# EasyEDA Pro project ProPrj_Starcat_FOC双路矢量控制器_2024-11-11.epro, board 双路大功率矢量控制器_3 (continued)
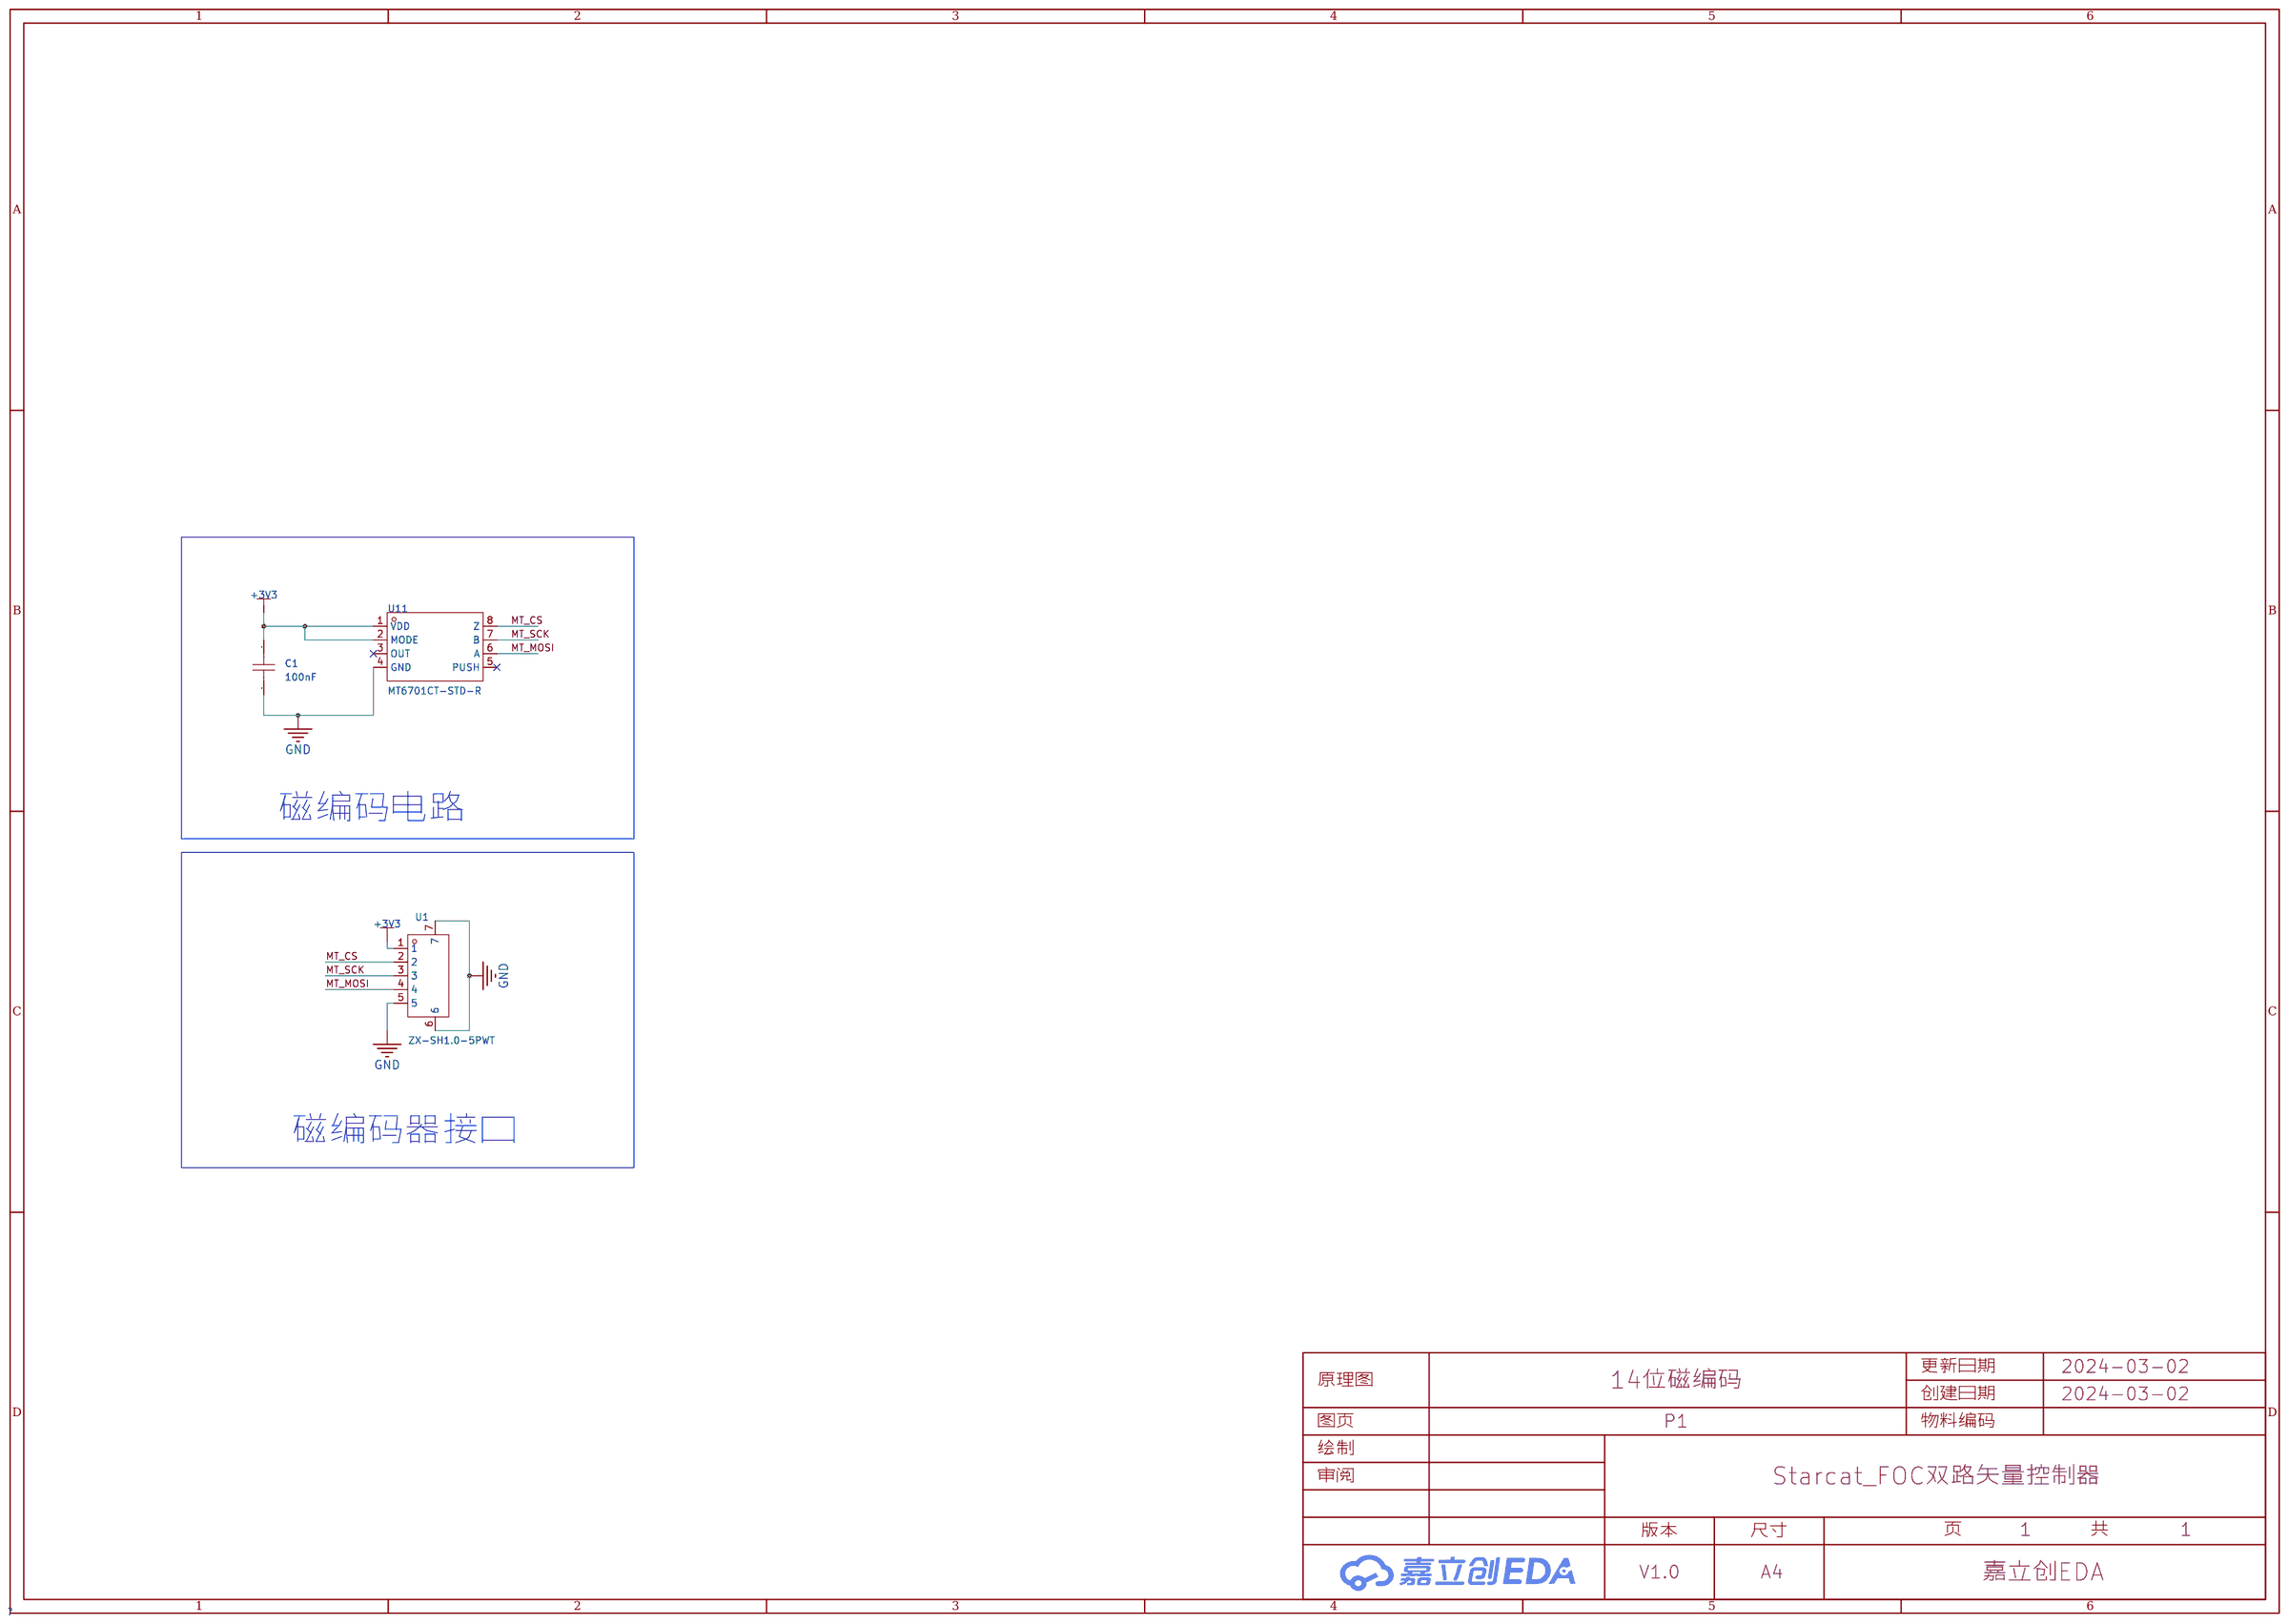
[diagram p0: schematic sheet]
## Routing (per net, layer and track width the routed paths; a pad name or vN(x,y) marks a point on that pad's centre or on a via; arc(x,y) is an arc through that point) (continued)
SL_C_1: length 40.8
  Top Layer w0.305: v1(65.74,32.13) 65.74,36.45 67.11,37.81 U15.34 ; 61.48,32.93 61.48,32.16 v1(61.47,32.15)
  Inner1 w0.305: 59.44,31.24 60.56,31.24 v1(61.47,32.15) 61.47,32.56 61.93,33.02 65.36,33.02 65.74,32.64 v1(65.74,32.13) ; 59.43,31.24 51.77,31.24 50.76,30.23 50.76,19.68 51.14,19.3 53.17,19.3 53.54,19.68 v1(53.54,20.04)
  vias: v1(51.7,23.02) v1(51.74,21.93) v1(51.8,20.65) v1(52.06,22.48) v1(52.01,21.33) v1(52.14,20.05) v1(52.36,23.03) v1(52.43,21.93) v1(52.47,20.66) v1(52.64,21.34) v1(52.7,22.49) v1(52.83,20.02) v1(52.99,23.03) v1(53.09,21.9) v1(53.12,20.64) v1(53.27,21.28) v1(53.34,22.49) v1(53.64,23.04) v1(53.71,21.89) v1(53.8,20.63) v1(53.95,22.5) v1(53.92,21.27)
SL_C_2: length 29.7
  Top Layer w0.305: 23.39,32.98 23.21,32.79 23.21,32.14 v1(22.96,31.89) ; v1(25.36,35.56) 24.74,36.18 U16.34
  Inner1 w0.305: v1(24.41,20.03) 24.41,18.86 24.1,18.55 22.17,18.55 21.67,19.05 21.67,30.61 v1(22.96,31.89) 22.96,34.56 23.96,35.56 v1(25.36,35.56)
  vias: v1(22.57,23) v1(22.61,21.91) v1(22.66,20.64) v1(22.88,21.32) v1(22.92,22.46) v1(23,20.04) v1(23.23,23.02) v1(23.3,21.91) v1(23.33,20.65) v1(23.57,22.48) v1(23.51,21.33) v1(23.69,20.01) v1(23.86,23.02) v1(23.95,21.89) v1(23.99,20.63) v1(24.14,21.27) v1(24.21,22.48) v1(24.5,23.03) v1(24.57,21.88) v1(24.67,20.62) v1(24.78,21.26) v1(24.82,22.49)
SO1_1: length 30.9
  Top Layer w0.305: R32.1 66,53.46 C66.2 65.98,54 64.85,55.12 62.19,55.12 60.92,53.85 v1(60.92,50.67) ; v1(46.97,44.76) 46.73,44.53 U12.9
  Bottom Layer w0.305: v1(60.92,50.67) 60.92,49.01 60.14,48.23 53.4,48.23 52.15,46.99 49.23,46.99 47.01,44.76 v1(46.97,44.76)
SO1_2: length 44.9
  Top Layer w0.305: U12.11 46.45,43.53 v1(46.56,43.42) ; v1(21.29,54.41) 21.29,54.84 21.45,54.99 23.07,54.99 23.51,54.55 C67.2 23.52,53.46 R34.1
  Inner1 w0.305: v1(21.29,54.41) 21.29,54.46 21.8,54.97 22.72,54.97 23.45,54.23 23.45,47.75 24.21,46.99 33.81,46.99 35.39,45.41 35.39,42.54 36.03,41.91 46.19,41.91 46.56,42.29 v1(46.56,43.42)
SO2_1: length 28.8
  Top Layer w0.305: v1(46.82,45.59) 46.25,45.03 U12.8 ; v1(60.31,49.26) 61.38,49.26 61.53,49.4 61.53,53.7 62.44,54.61 64.22,54.61 64.85,53.97 C70.2 R36.1
  Bottom Layer w0.305: v1(60.31,49.26) 59.69,48.64 53.04,48.64 51.9,47.5 48.73,47.5 v1(46.82,45.59)
SO2_2: length 43.2
  Top Layer w0.305: R38.1 22.34,53.43 C73.2 22.37,54.04 v1(22.06,54.36) ; v1(47.17,43.91) 47.06,44.03 U12.10
  Inner1 w0.305: v1(47.17,43.91) 47.2,43.88 47.2,42.16 46.44,41.4 35.77,41.4 34.88,42.29 34.88,45.34 33.74,46.48 23.71,46.48 22.94,47.24 22.94,53.97 22.56,54.36 v1(22.06,54.36)
SPI_MISO: length 56.4
  Top Layer w0.305: U16.10 31.24,49.39 30.91,49.72 ; v1(73.5,50.8) 73.61,50.69 U15.10 ; 30.91,49.77 30.87,49.81 ; v1(53.84,53.75) 53.2,53.75 52.5,53.05 U12.52
  Inner1 w0.305: 30.9,49.74 30.9,50.02 30.78,50.13 ; v1(73.5,50.8) 72.35,51.94 55.96,51.94 54.16,53.75 v1(53.84,53.75) 53.2,53.75 52.13,52.68 35.57,52.68 35.26,52.38 35.26,50.04 34.63,49.4 31.21,49.4 30.95,49.67
  vias: v1(30.87,50.03)
SPI_MOSI: length 56.2
  Top Layer w0.305: v1(31.63,50.04) 31.74,49.93 U16.9 ; U12.53 52,53.41 v1(52.52,53.93) ; U15.9 74.11,51.41 v1(74.13,51.43)
  Inner1 w0.305: v1(31.63,50.04) 34.5,50.04 34.76,50.29 34.76,52.83 35.17,53.24 51.83,53.24 v1(52.52,53.93) 53.07,54.48 54.19,54.48 56.22,52.45 73.11,52.45 v1(74.13,51.43)
SPI_SCK: length 53
  Top Layer w0.305: U16.11 30.74,49.1 30.31,49.53 v1(30.29,49.53) ; U15.11 73.11,49.91 ; U12.51 53,52.5 v1(53.5,53.01)
  Inner1 w0.305: v1(72.94,50.13) 71.63,51.43 55.71,51.43 54.14,53.01 v1(53.5,53.01) 51.93,51.43 36.97,51.43 36.66,51.13 36.66,49.53 36.03,48.89 30.93,48.89 v1(30.29,49.53)
SW1: length 53
  Top Layer w0.305: v1(49.74,36.32) 50,36.58 U12.24 ; v1(84.64,23.49) 83.9,23.49 83.4,24 83.4,28.87 v1(81.4,30.86)
  Bottom Layer w0.305: v1(49.74,36.32) 49.74,33.53 52.41,30.86 67.27,30.86 67.57,30.56 81.1,30.56 v1(81.4,30.86) ; 87.51,21.06 87.51,21.45 87.19,21.78 84.93,21.78 84.44,22.26 84.44,23.71
SW2: length 64.3
  Top Layer w0.305: U12.21 v1(48.5,35.56) ; v1(84.64,18.29) 83.78,18.29 83.27,18.8 83.27,22.35 83.78,22.86 84.92,22.86 85.3,23.24 85.3,24 84.79,24.51 84.16,24.51 83.94,24.73 83.94,25.03 83.98,25.07 83.98,29.62 81.97,31.62 v1(81.11,31.62)
  Bottom Layer w0.305: v1(81.11,31.62) 80.48,30.99 67.9,30.99 67.52,31.37 52.66,31.37 50.63,33.4 50.63,36.7 50.12,37.21 48.98,37.21 48.5,36.73 v1(48.5,35.56) ; 84.74,17.94 84.74,16.06 85.11,15.69 86.03,15.69 86.15,15.81
SWCLK: length 8.9
  Top Layer w0.305: v1(54.82,50.42) 54.71,50.53 U12.49
  Bottom Layer w0.305: v1(54.82,50.42) 54.38,49.98 48.47,49.98 48.03,50.42 47.96,50.42 47.84,50.53 CN1.2
SWDIO: length 19.9
  Top Layer w0.305: U12.46 57.71,47.53 59.92,49.74 v1(59.92,50.78)
  Bottom Layer w0.305: v1(59.92,50.78) 59.92,52.18 59.52,52.58 53.93,52.58 53.55,52.2 52.41,52.2 51.9,52.7 49.74,52.7 48.84,51.81 CN1.3
TEMP1: length 21.8
  Top Layer w0.305: R21.1 64.48,30.1 v1(63.93,30.1) ; U12.25 50.5,36.08 51.14,35.43 52.86,35.43 53.38,34.91 C35.2 53.45,34.54 v1(55.46,34.54)
  Inner2 w0.305: v1(55.46,34.54) 55.46,31.37 56.09,30.73 63.29,30.73 v1(63.93,30.1)
TEMP2: length 21
  Top Layer w0.305: U12.20 48,35.97 47.2,35.18 v1(47.07,35.18) 47.03,35.13 C36.2 48.19,34.48 R25.2
  Bottom Layer w0.305: v1(37.16,30.23) 46.69,30.23 47.07,30.61 v1(47.07,35.18)
TX: length 51.3
  Top Layer w0.305: U12.14 46.32,42.03 46.82,41.53 v1(46.82,40.64)
  Inner1 w0.305: v1(13.55,43.82) 21.3,43.82 v1(22.31,44.83)
  Bottom Layer w0.305: v1(46.82,40.64) 23.2,40.64 22.31,41.53 v1(22.31,44.83) 22.31,52.32 22.44,52.45 U4.7 ; CN2.2 v1(13.55,43.82)
V_BUS: length 7.2
  Top Layer w0.305: R23.2 R20.1 49.57,35.35 49,35.92 U12.22
$1N4243: length 16.2
  Top Layer w0.305: C17.2 18.54,50.51 18.89,50.16 19.4,50.16 21.61,47.94 21.61,46.29 22.18,45.72 22.33,45.72 v1(23.09,44.96)
  Bottom Layer w0.305: U4.8 23.09,50.67 v1(23.09,44.96)
$1N23108: length 1
  Top Layer w0.305: 49.74,53.09 50.71,53.09 LED2.2
$1N53421: length 1.3
  Top Layer w0.305: 14.09,35.94 14.16,36.01 R7.1
$1N65020: length 6.3
  Top Layer w0.305: C13.2 57.55,37.74 57.2,37.39 53.8,37.39 53.5,37.7 U12.31
$1N65024: length 4.7
  Top Layer w0.305: U12.47 57.64,48.03 58.89,49.28 C14.2
$1N65085: length 2.7
  Top Layer w0.305: U12.60 48.5,52.86 48.73,53.09
$1N74568: length 2.7
  Bottom Layer w0.762: D1.1 15.55,37.16 F1.2
$1N75995: length 1.8
  Top Layer w0.305: LED1.2 88.02,33.03 R1.1
$1N76797: length 17.5
  Bottom Layer w0.305: C24.1 76.28,33.65 79.71,33.65 80.5,34.44 80.5,43.66 79.97,44.2 78.04,44.2 U10.3
$1N76851: length 12.6
  Bottom Layer w0.305: U10.6 79.79,42.09 80.09,41.79 80.09,34.8 79.7,34.41 R19.2
$1N77635: length 3.8
  Bottom Layer w0.305: U6.3 83.03,52.01 83.09,52.07 83.4,52.07 83.68,51.78 R11.1 84.78,50.62 R15.2
$1N77907: length 5.8
  Bottom Layer w0.305: L5.1 78.62,54.86 82.13,54.86 82.38,54.61 82.38,54.03 U6.1
$2N6130: length 8.1
  Top Layer w0.305: 84.03,50.81 84.03,50.29 83.78,50.04 81.87,50.04 81.31,49.48 78.48,49.48 78.11,49.1 U15.1
$2N6321: length 7.4
  Top Layer w0.305: U15.52 76.11,41.73 76.41,42.04 78.82,42.04 79.08,41.78 79.08,40.64 79.46,40.25 C50.2
$2N6405: length 15.3
  Top Layer w0.762: C50.1 82.14,41.44 L2.1 ; L2.1 84.61,41.96 D3.2 ; L2.1 80.78,42.8 76.13,42.8 75.36,42.04 75.36,40.08
$2N6739: length 4.5
  Top Layer w0.305: R29.2 R28.2 78.06,50.55 77.96,50.44 77.89,50.44 77.11,49.66 U15.3
$2N6794: length 4.4
  Top Layer w0.305: R31.1 75.53,50.81 75.11,50.38 U15.7
$2N8342: length 2.2
  Top Layer w0.305: 81.87,52.32 81.78,52.32 80.39,50.92 C46.2
$2N8350: length 7.5
  Top Layer w0.305: U15.2 77.61,49.58 78.06,50.04 80.9,50.04 81.67,50.81 82.92,50.81 82.93,50.81
$2N8743: length 8.5
  Top Layer w0.305: U15.33 66.61,38.2 63.46,35.05 C64.2 64.55,34.48 R33.1
$2N8848: length 10.3
  Top Layer w0.305: U15.31 65.61,38.85 62.19,35.43 60.54,35.43 60.29,35.19 C72.2 ; 60.4,34.52 60.43,34.55 61.4,34.55 ; 61.46,34.58 61.47,34.57
$2N8926: length 9.1
  Top Layer w0.305: C52.1 80.05,34.48 78.34,36.19 77.43,36.19 74.11,39.52 U15.48
$2N9079: length 7.5
  Top Layer w0.305: C55.1 75.15,34.92 71.61,38.46 U15.43
$2N9128: length 6.5
  Top Layer w0.305: C60.1 70.15,35.09 69.11,36.13 U15.38
$2N9379: length 2.9
  Top Layer w0.305: U15.25 66.11,50.7 R32.2
$2N9879: length 3
  Top Layer w0.305: C62.1 67.39,50.85 67.39,49.28 67.11,48.99 U15.23
$2N9964: length 5.9
  Top Layer w0.305: 71.62,48.28 71.62,52.76 71.41,52.97 70.3,52.97 70.28,52.96
$2N9968: length 4.2
  Top Layer w0.305: 70.05,51.57 70.07,51.59 70.79,51.59 71.08,51.3 71.08,48.24
$2N10075: length 3.6
  Top Layer w0.305: 72.09,48.22 72.09,51.3 72.44,51.65
$2N10523: length 12.5
  Top Layer w0.305: Q5.4 48.91,29.78 48.6,30.1 41.96,30.1 38.98,33.08 R43.2
$2N10526: length 21
  Top Layer w0.305: Q10.4 v1(44.08,18.98) ; R48.2 37.31,32.37 37.3,32.35 v1(37.3,32.13)
  Inner1 w0.305: v1(44.08,18.98) 40.67,18.98 39.96,19.68 39.96,31.62 39.45,32.13 v1(37.3,32.13)
$2N10840: length 9.3
  Top Layer w0.305: Q6.4 39.41,30.65 39.07,30.99 34.62,30.99 34.01,31.6 R44.2
$2N10842: length 18.2
  Top Layer w0.305: v1(32.31,31.83) 32.31,33.04 R49.2 ; Q11.4 v1(34.55,18.98)
  Inner1 w0.305: v1(32.31,31.83) 32.31,24.28 32.72,23.88 34.76,23.88 35.52,23.11 35.52,19.3 35.14,18.92 34.61,18.92 v1(34.55,18.98)
$2N11117: length 4.9
  Top Layer w0.305: R45.2 28.79,32.97 28.79,31.5 29.91,30.37 Q7.4
$2N11119: length 21.4
  Top Layer w0.305: Q12.4 24.84,18.98 v1(25.05,19.19) ; R50.2 v1(27.14,31.88)
  Inner1 w0.305: v1(27.14,31.88) 27.14,32.38 26.75,32.77 24.6,32.77 23.7,31.87 23.7,24.27 24.09,23.88 25.61,23.88 25.99,23.49 25.99,20.13 v1(25.05,19.19)
$2N13932: length 3.4
  Top Layer w0.305: U16.7 32.72,48.1 32.72,50.29 33.03,50.6 R30.1
$2N13948: length 7.5
  Top Layer w0.305: R35.1 25.81,34.48 C65.2 24.74,35.16 24.24,35.66 U16.33
$2N13963: length 8
  Top Layer w0.305: R39.1 23.19,34.55 ; 23.34,34.47 23.34,34.48 22.06,34.48 C75.2 22.06,35.05 23.24,36.24 U16.31
$2N13976: length 11.9
  Top Layer w0.305: 40.61,34.59 40.56,34.59 35.78,39.37 32.09,39.37 31.74,39.72 U16.48
$2N13991: length 10.3
  Top Layer w0.305: U16.43 29.24,38.72 30.92,37.05 33.52,37.05 35.66,34.91 35.66,34.59
$2N14006: length 7.7
  Top Layer w0.305: U16.38 26.74,37.86 30.01,34.59 30.33,34.59
$2N14021: length 3.2
  Top Layer w0.305: U16.26 23.24,49.36 22.34,50.26 R38.2
$2N14030: length 2.9
  Top Layer w0.305: R34.2 23.52,49.84 23.74,49.62 U16.25
$2N14048: length 3.4
  Top Layer w0.305: C69.2 21.14,50.75 22.74,49.15 U16.27
$2N14053: length 2.8
  Top Layer w0.305: U16.23 24.74,50.84 C63.1
$2N14079: length 3.3
  Top Layer w0.305: C59.2 28.27,50.86 29.24,49.89 U16.14
$2N14081: length 5.3
  Top Layer w0.305: U16.15 28.74,49.7 28.29,50.16 27.74,50.16 27.44,50.46 27.44,51.7 28,52.26 28.02,52.26
$2N14085: length 2.9
  Top Layer w0.305: C56.2 29.68,50.73 29.68,48.13 U16.13
$2N14090: length 4.6
  Top Layer w0.305: R40.2 78.45,31.25 77.93,30.73 Q2.4
$2N14092: length 18.7
  Top Layer w0.305: v1(73.24,19.05) 72.35,19.05 Q13.4 ; v1(76.9,32.04) 76.9,32.97 76.88,32.98
  Inner1 w0.305: v1(76.9,32.04) 77.55,31.39 77.55,20.4 76.17,19.01 73.25,19.01
$2N14112: length 9
  Top Layer w0.305: R41.2 73.5,32.37 73.49,32.36 73.49,31.42 73.19,31.11 69.05,31.11 68.43,30.5 Q3.4
$2N14114: length 22
  Top Layer w0.305: R46.2 71.9,32.19 71.59,31.88 v1(71.33,31.88) ; v1(63.84,19.27) 63.55,18.98 Q8.4
  Inner1 w0.305: v1(63.84,19.27) 68.25,19.27 68.54,19.56 68.54,30.61 68.92,30.99 70.57,30.99 71.33,31.75 v1(71.33,31.88)
$2N14127: length 12.5
  Top Layer w0.305: Q4.4 58.93,30.4 59.49,30.96 66.43,30.96 R42.2
$2N14129: length 26.3
  Top Layer w0.305: R47.2 66.89,33.07 66.89,32 66.25,31.37 59.14,31.37 v1(57.87,30.1) ; Q9.4 v1(54.19,18.98)
  Inner1 w0.305: v1(57.87,30.1) 57.87,19.61 57.23,18.98 v1(54.19,18.98)
$2N20113: length 3.5
  Top Layer w0.305: U15.27 65.11,49.02 63.71,50.42 63.71,50.86
$2N20114: length 3.2
  Top Layer w0.305: R36.2 64.85,50.04 65.61,49.29 U15.26
$2N20875: length 1
  Bottom Layer w0.305: 12.77,23.17 12.77,24.07 12.68,24.16
$2N21611: length 3.6
  Top Layer w0.305: 80.38,38.99 78.41,38.99 78.11,39.29 U15.56

## Copper pours and planes (outline as drawn; the poured copper is in the pictures)
AGND on Top Layer: -4.87,59.37 103.34,59.37 103.34,-3.49 -4.87,-3.49
AGND on Bottom Layer: -7.66,60.2 100.54,60.2 100.54,-2.67 -7.66,-2.67
AGND on Inner1: -6.79,58.95 101.42,58.95 101.42,-3.91 -6.79,-3.91
AGND on Inner2: -10.04,60.26 98.16,60.26 98.16,-2.61 -10.04,-2.61
PGND on Top Layer: 70.2,23.29 73.5,23.29 73.5,19.74 70.2,19.74
PGND on Top Layer: 41.15,23.28 44.46,23.28 44.46,19.73 41.15,19.73
PGND on Bottom Layer: 70.19,23.28 73.49,23.28 73.49,19.72 70.19,19.72
PGND on Bottom Layer: 41.15,23.27 44.45,23.27 44.45,19.71 41.15,19.71
PGND on Bottom Layer: 13.84,23.61 81.7,23.61 81.7,15.08 13.84,15.08
PGND on Inner1: 41.15,23.27 44.45,23.27 44.45,19.71 41.15,19.71
PGND on Inner1: 70.19,23.28 73.49,23.28 73.49,19.72 70.19,19.72
PGND on Inner2: 41.15,23.27 44.45,23.27 44.45,19.71 41.15,19.71
PGND on Inner2: 70.19,23.28 73.49,23.28 73.49,19.72 70.19,19.72
PGND on Inner2: 13.83,23.6 81.69,23.6 81.69,15.06 13.83,15.06
AO_1 on Top Layer: 73.74,27.86 80.85,27.86 80.85,18.46 73.74,18.46
AO_1 on Top Layer: 68.06,18.88 79.3,18.88 79.3,11.65 68.06,11.65
AO_2 on Top Layer: 44.73,27.81 51.84,27.81 51.84,18.41 44.73,18.41
AO_2 on Top Layer: 38.82,18.91 50.44,18.91 50.44,11.68 38.82,11.68
BO_1 on Top Layer: 64.25,19.15 70.11,19.15 70.11,11.78 64.25,11.78
BO_1 on Top Layer: 64.35,27.82 71.46,27.82 71.46,18.41 64.35,18.41
BO_2 on Top Layer: 35.07,27.81 42.31,27.81 42.31,18.41 35.07,18.41
BO_2 on Top Layer: 35.01,19.18 40.92,19.18 40.92,11.81 35.01,11.81
CO_1 on Top Layer: 54.69,27.82 61.93,27.82 61.93,18.41 54.69,18.41
CO_1 on Top Layer: 54.73,19.59 64.28,19.59 64.28,11.78 54.73,11.78
CO_2 on Top Layer: 25.61,19.56 35.04,19.56 35.04,11.76 25.61,11.76
CO_2 on Top Layer: 25.55,27.81 32.79,27.81 32.79,18.41 25.55,18.41
DCBUS on Bottom Layer: 13.93,29.44 81.8,29.44 81.8,24 13.93,24
DCBUS on Inner2: 13.8,29.48 81.8,29.48 81.8,24.04 13.8,24.04
SL_B_1 on Top Layer: 60.78,23.29 64.08,23.29 64.08,19.74 60.78,19.74
SL_B_1 on Bottom Layer: 60.77,23.28 64.08,23.28 64.08,19.72 60.77,19.72
SL_B_1 on Inner1: 60.77,23.28 64.08,23.28 64.08,19.72 60.77,19.72
SL_B_1 on Inner2: 60.77,23.28 64.08,23.28 64.08,19.72 60.77,19.72
SL_B_2 on Top Layer: 31.61,23.28 34.91,23.28 34.91,19.73 31.61,19.73
SL_B_2 on Bottom Layer: 31.6,23.27 34.9,23.27 34.9,19.71 31.6,19.71
SL_B_2 on Inner1: 31.6,23.27 34.9,23.27 34.9,19.71 31.6,19.71
SL_B_2 on Inner2: 31.6,23.27 34.9,23.27 34.9,19.71 31.6,19.71
SL_C_1 on Top Layer: 51.15,23.29 54.45,23.29 54.45,19.74 51.15,19.74
SL_C_1 on Bottom Layer: 51.15,23.28 54.45,23.28 54.45,19.72 51.15,19.72
SL_C_1 on Inner1: 51.15,23.28 54.45,23.28 54.45,19.72 51.15,19.72
SL_C_1 on Inner2: 51.15,23.28 54.45,23.28 54.45,19.72 51.15,19.72
SL_C_2 on Top Layer: 22.02,23.28 25.32,23.28 25.32,19.73 22.02,19.73
SL_C_2 on Bottom Layer: 22.01,23.27 25.31,23.27 25.31,19.71 22.01,19.71
SL_C_2 on Inner1: 22.01,23.27 25.31,23.27 25.31,19.71 22.01,19.71
SL_C_2 on Inner2: 22.01,23.27 25.31,23.27 25.31,19.71 22.01,19.71

Small or netless copper shapes (teardrops, artwork), in the pictures only: 473 on Top Layer, 245 on Bottom Layer, 117 on Inner1, 40 on Inner2

## Text on the board
Bottom Silkscreen Layer: NRST | SW1 | SW2 | TX | RX | 3V3 | GND | CAN_L | CAN_H | SWC | SWD | 2024年8月27日 | Enc1 | Enc0 | - | + | M1 | M0 | +5V | SERVO1 | 双路FOC驱动V2.0 | 电源输入
Top Silkscreen Layer: 串口指示灯 | LED1 | 3V3指示灯 | + | - | 15A / 单路 | 48V | —— | MOSI/Z | SCK/B | 3V3 | CS/A | GND | +5V | SERVO0 | |DRV8301
